# EasyEDA Pro project C108_STM32.eprj, schematic Schematic7
Board Name: 运输车_下层; Create Date: 2025-01-10; Page Name: P1; Project Name: C108_STM32; Schematic Name: Schematic7; Update Date: 2025-01-18; Company: 嘉立创EDA; Page Size: A4; Version: V1.0
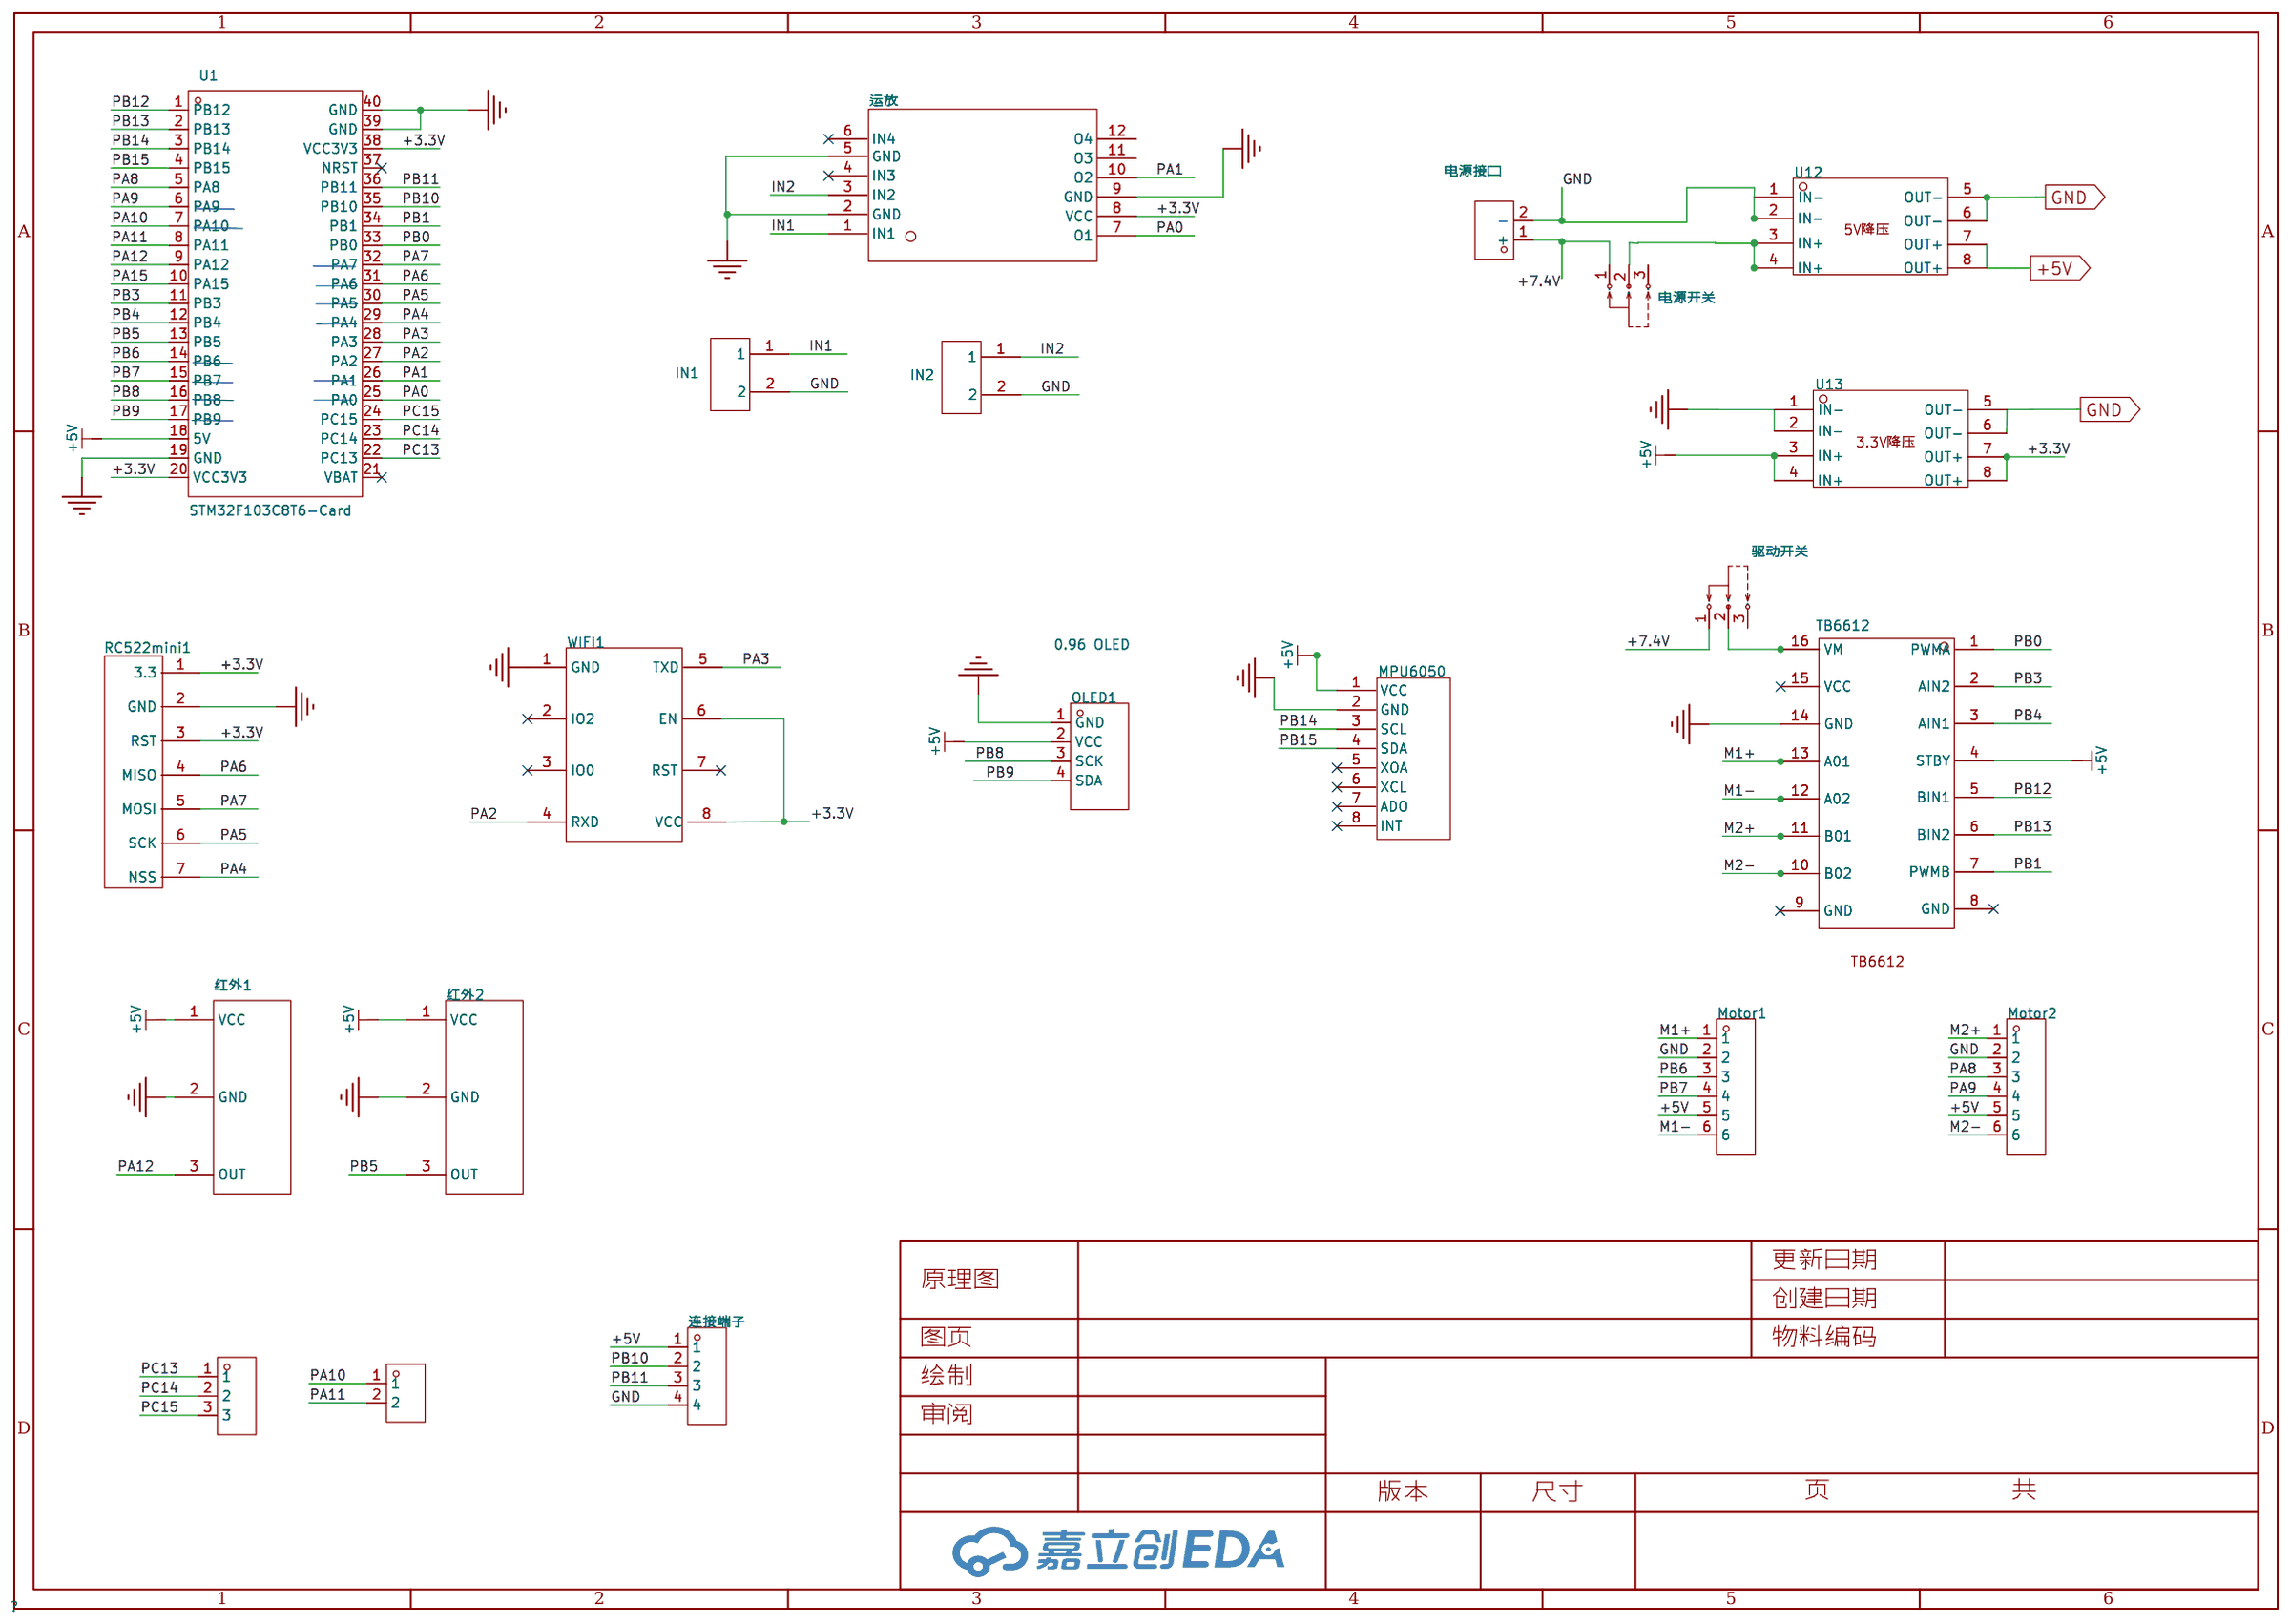
[diagram p6: schematic sheet]

## Parts
H1  -  [HDR-TH_3P-P2.54-V-F]
IN1  -  [dianganxie]
IN2  -  [dianganxie]
Motor1  BX-ZH1.5-6PWZ  [CONN-TH_ZH1.5-6AW_C2829757]
Motor2  BX-ZH1.5-6PWZ  [CONN-TH_ZH1.5-6AW_C2829757]
MPU6050  -  [MPU6050]
OLED1  0.96 OLED  [HDR-TH_4P-P2.54-V-M-1]
RC522mini1  -  [RC522mini]
TB6612  -  [TB6612_Board]
U1  STM32F103C8T6-Card  [CONN-TH_L53.3-W22.9_STM32F103C8T6-CARD]
U12  -  [降压mini]
U13  -  [3.3V降压]
U14  单排2.54*2  [HDR-TH_2P-P2.54-V-M-1]
WIFI1  -  [ESP-01]
电源开关  电源开关  [SW-TH_SHOU-HAN_SS12D10G4]
电源接口  XH2.54*2P_直插  [CONN-TH_2P-P2.50-XH2.54-2P]
红外1  -  [红外避障]
红外2  -  [红外避障]
运放  -  [逐飞运放]
连接端子  2.54*4单排  [HDR-TH_4P-P2.54-V-M-1]
驱动开关  驱动开关  [SW-TH_SHOU-HAN_SS12D10G4]

## Library data of the parts
H1 = HDR-F_2.54_1x3P: Supplier Part: C541850; Supplier Footprint: 插件
IN1 IN2 = dianganxie
Motor1 Motor2 = BX-ZH1.5-6PWZ: Supplier Part: C18077740; Manufacturer: Bossie(博锡); Supplier Footprint: 弯插,P=1.5mm; JLCPCB Part Class: 扩展库; Datasheet: https://atta.szlcsc.com/upload/public/pdf/source/20231017/5A4E9FE20877BDD2F3FB1D1F8B5EF450.pdf; Supplier: LCSC; Pins Structure: 1x6P; Pitch: 1.5mm; Mounting Style: 弯插; Reference Series: ZH; Number of Pins: 6P; Number of Rows: 1; Number of PINs Per Row: 6; Current Rating (Max): 3A; Contact Material: 黄铜; Contact Plating: 锡; Operating Temperature Range: -25℃~+85℃
MPU6050 = MPU6050
OLED1 连接端子 = 2.54*4单排: Supplier Part: C9900016163; Supplier Footprint: 2.54x4; JLCPCB Part Class: 扩展库; Supplier: LCSC
RC522mini1 = RC522mini
TB6612 = TB6612_Board
U1 = STM32F103C8T6-Card: Supplier Part: C9900077949; Supplier Footprint: 插件; Supplier: LCSC
U12 = 降压mini
U13 = 3.3V降压
U14 = 单排2.54*2: Supplier Part: C9900016158; Supplier Footprint: 2.54x2; JLCPCB Part Class: 扩展库; Supplier: LCSC
WIFI1 = ESP-01
电源开关 驱动开关 = SS12D10开关: LCSC Part Name: SS12D10/G5/直角; Supplier Part: C9900029541; Supplier Footprint: THrough hole; JLCPCB Part Class: 扩展库; Supplier: LCSC
电源接口 = XH2.54*2P_直插: Supplier Part: C9900008615; Supplier Footprint: XH2.54_2P; Supplier: LCSC
红外1 红外2 = 红外避障
运放 = 逐飞运放

## Nets
+3.3V: RC522mini1.1(3.3) RC522mini1.3(RST) U1.20(VCC3V3) U1.38(VCC3V3) U13.7(OUT+) U13.8(OUT+) WIFI1.6(EN) WIFI1.8(VCC) 运放.8(VCC)
+5V: Motor1.5 Motor2.5 MPU6050.1(VCC) OLED1.2(VCC) TB6612.4(STBY) U1.18(5V) U12.7(OUT+) U12.8(OUT+) U13.3(IN+) U13.4(IN+) 红外1.1(VCC) 红外2.1(VCC) 连接端子.1
+7.4V: 电源开关.1 电源接口.1(+) 驱动开关.1
GND: IN1.2 IN2.2 Motor1.2 Motor2.2 MPU6050.2(GND) OLED1.1(GND) RC522mini1.2(GND) U1.19(GND) U1.39(GND) U1.40(GND) U12.2(IN-) U12.6(OUT-) U13.2(IN-) U13.6(OUT-) WIFI1.1(GND) 电源接口.2(-) 红外1.2(GND) 红外2.2(GND) 运放.2(GND) 运放.5(GND) 运放.9(GND) 连接端子.4
IN1: IN1.1 运放.1(IN1)
IN2: IN2.1 运放.3(IN2)
M1+: Motor1.1 TB6612.13(A01)
M1-: Motor1.6 TB6612.12(A02)
M2+: Motor2.1 TB6612.11(B01)
M2-: Motor2.6 TB6612.10(B02)
PA0: U1.25(PA0) 运放.7(O1)
PA1: U1.26(PA1) 运放.10(O2)
PA2: U1.27(PA2) WIFI1.4(RXD)
PA3: U1.28(PA3) WIFI1.5(TXD)
PA4: RC522mini1.7(NSS) U1.29(PA4)
PA5: RC522mini1.6(SCK) U1.30(PA5)
PA6: RC522mini1.4(MISO) U1.31(PA6)
PA7: RC522mini1.5(MOSI) U1.32(PA7)
PA8: Motor2.3 U1.5(PA8)
PA9: Motor2.4 U1.6(PA9)
PA10: U1.7(PA10) U14.1
PA11: U1.8(PA11) U14.2
PA12: U1.9(PA12) 红外1.3(OUT)
PA15: U1.10(PA15)
PB0: TB6612.1(PWMA) U1.33(PB0)
PB1: TB6612.7(PWMB) U1.34(PB1)
PB3: TB6612.2(AIN2) U1.11(PB3)
PB4: TB6612.3(AIN1) U1.12(PB4)
PB5: U1.13(PB5) 红外2.3(OUT)
PB6: Motor1.3 U1.14(PB6)
PB7: Motor1.4 U1.15(PB7)
PB8: OLED1.3(SCK) U1.16(PB8)
PB9: OLED1.4(SDA) U1.17(PB9)
PB10: U1.35(PB10) 连接端子.2
PB11: U1.36(PB11) 连接端子.3
PB12: TB6612.5(BIN1) U1.1(PB12)
PB13: TB6612.6(BIN2) U1.2(PB13)
PB14: MPU6050.3(SCL) U1.3(PB14)
PB15: MPU6050.4(SDA) U1.4(PB15)
PC13: H1.1 U1.22(PC13)
PC14: H1.2 U1.23(PC14)
PC15: H1.3 U1.24(PC15)
$1N1778: TB6612.16(VM) 驱动开关.2
Net-(U12-3): U12.3(IN+) U12.4(IN+)

Not connected (* = marked no-connect by the designer): MPU6050 5(XOA)* 6(XCL)* 7(ADO)* 8(INT)*; TB6612 8(GND)* 9(GND)* 14(GND) 15(VCC)*; U1 21(VBAT)* 37(NRST)*; U12 1(IN-) 5(OUT-); U13 1(IN-) 5(OUT-); WIFI1 2(IO2)* 3(IO0)* 7(RST)*; 电源开关 2 3; 运放 4(IN3)* 6(IN4)* 11(O3) 12(O4); 驱动开关 3
